# EasyEDA Pro project Project_first.eprj, schematic Schematic7 (continued)
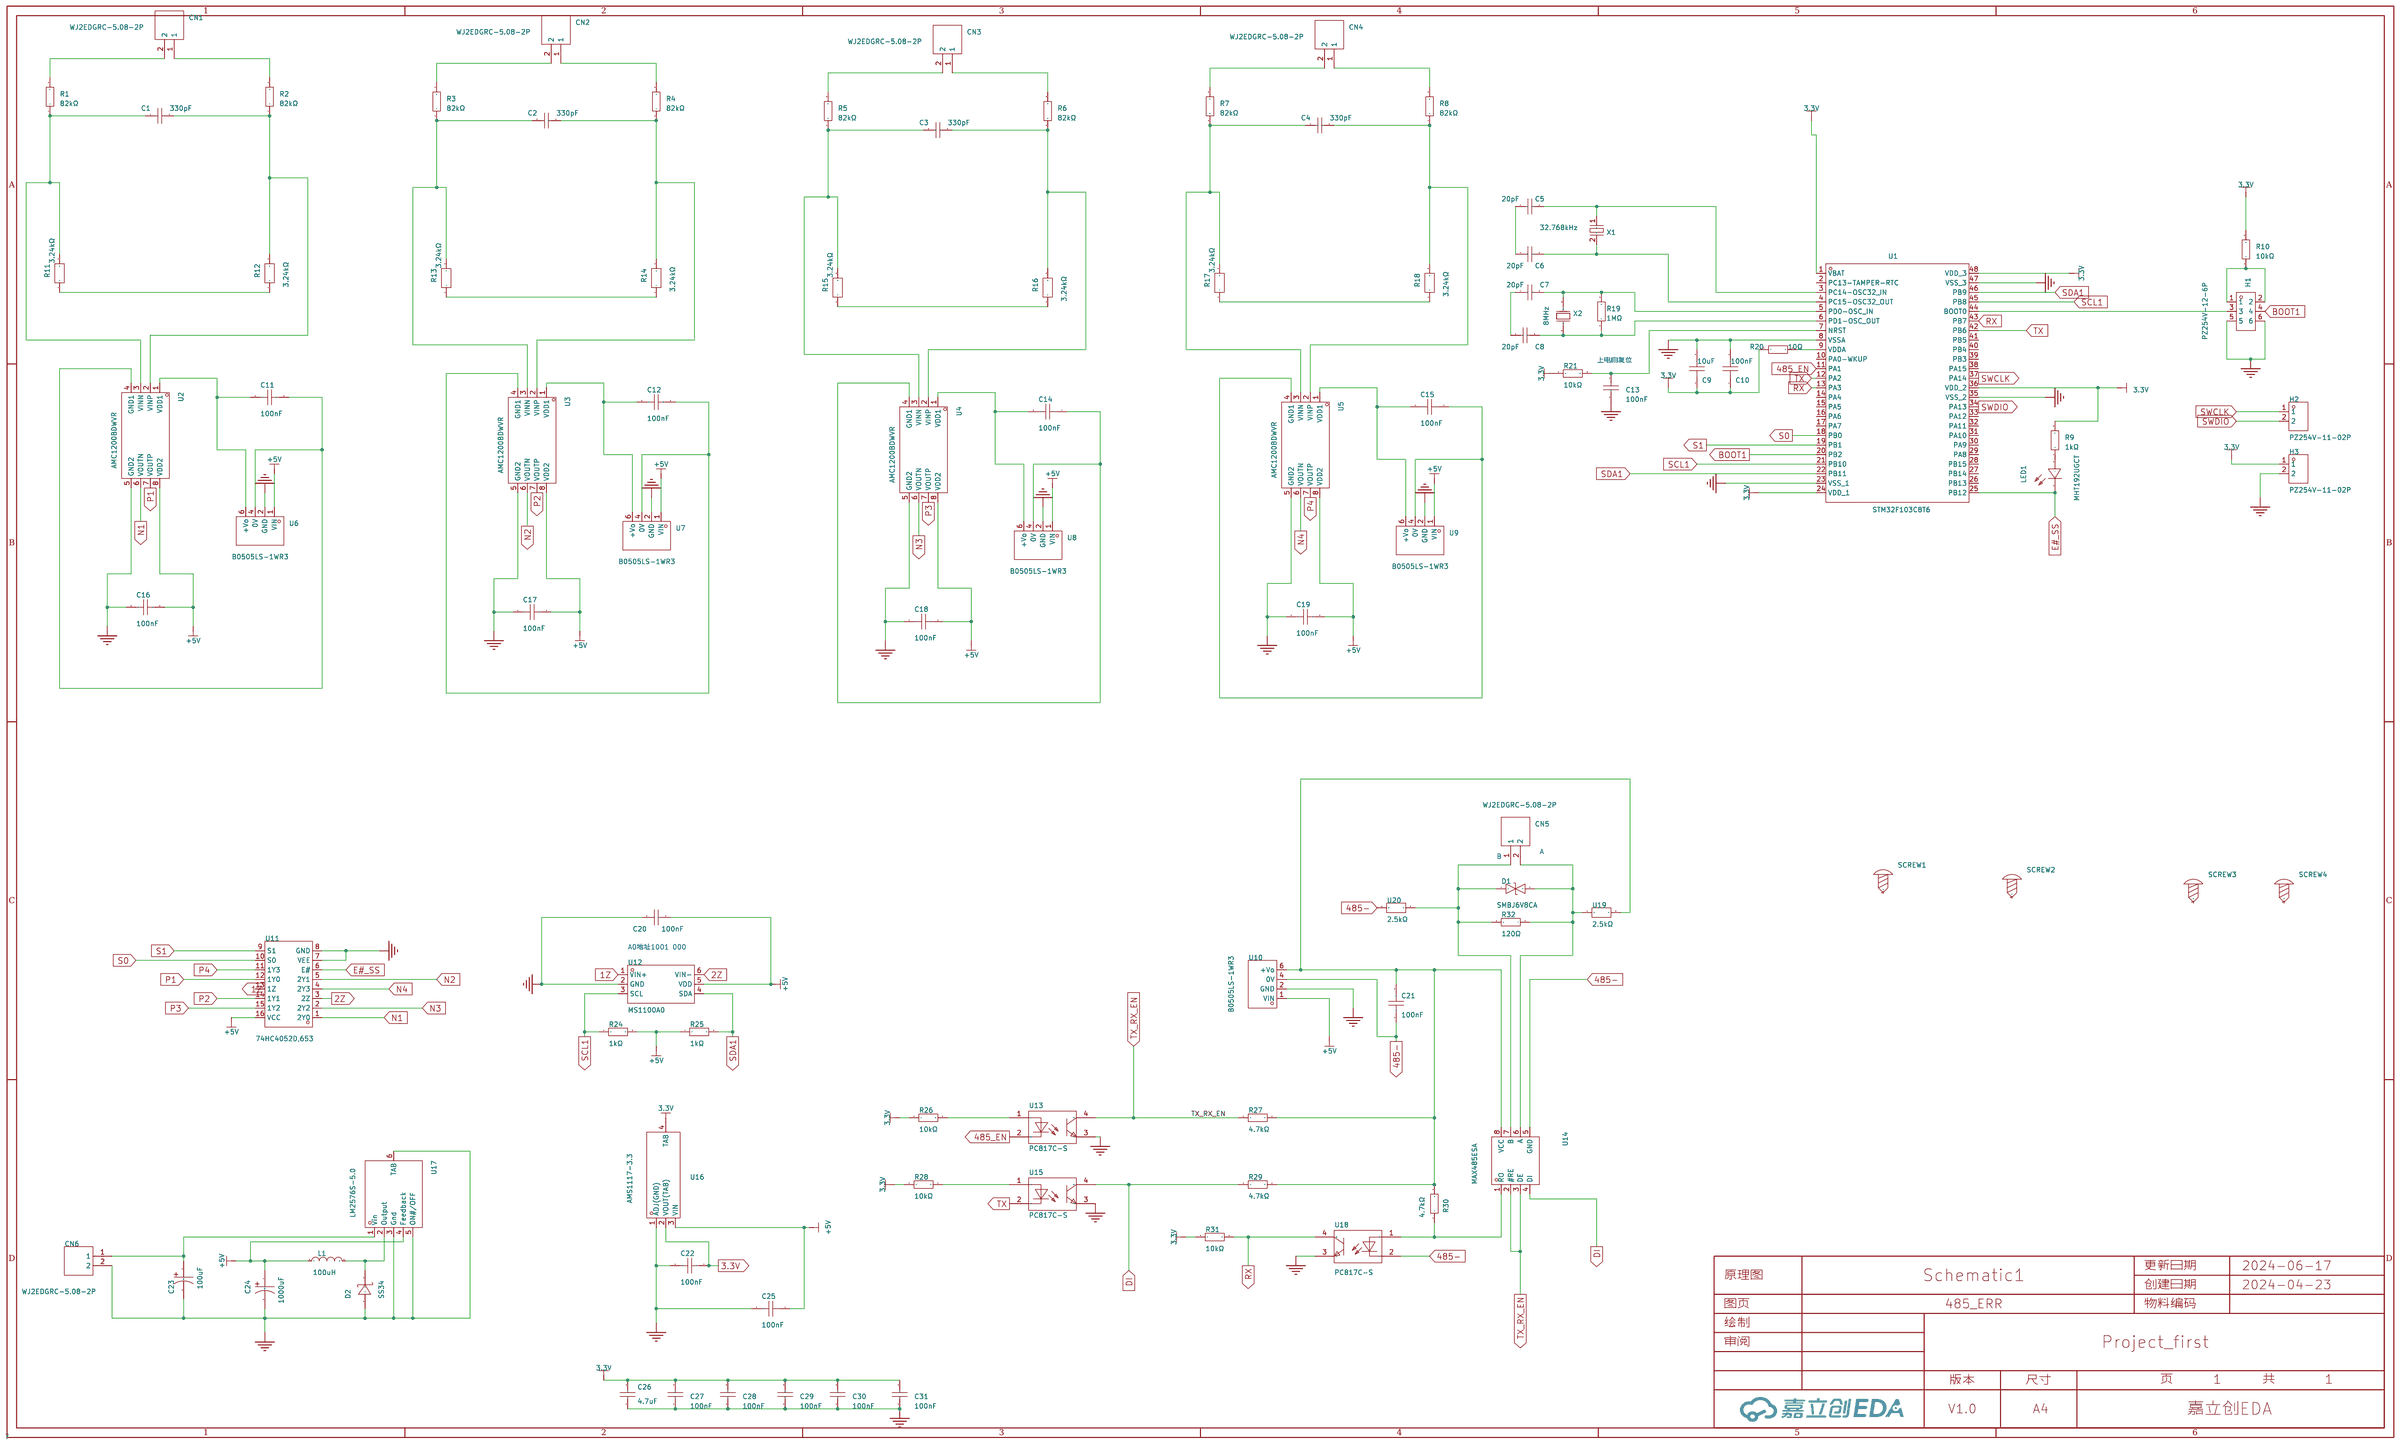
[diagram p0: schematic sheet]
## Library data of the parts (continued)
C7 C8 C10 C27 C33 = CC0603KRX7R9BB104: 容值:100nF;精度:±10%;额定电压:50V;材质(温度系数):X7R;; LCSC Part Name: 100nF ±10% 50V; Supplier Part: C14663; Manufacturer: YAGEO(国巨); Supplier Footprint: 0603; JLCPCB Part Class: Basic Part; Datasheet: https://atta.szlcsc.com/upload/public/pdf/source/20180910/C282072_33301C7F631E79921B82A8DAC6BCC5B3.pdf; Supplier: LCSC; Tolerance: ±10%; Voltage Rated: 50V; Temperature Coefficient: X7R
C16 = ERS1HM681W20OT: 容值:680uF;精度:±20%;额定电压:50V;; LCSC Part Name: 680uF ±20% 50V; Supplier Part: C106668; Manufacturer: AISHI(艾华集团); Supplier Footprint: 插件,D12.5xL20mm; JLCPCB Part Class: Extended Part; Datasheet: https://atta.szlcsc.com/upload/public/pdf/source/20191015/C438940_4B8E60A742BB0AE40DDEF87A5C89089D.pdf; Supplier: LCSC; Tolerance: ±20%; Rated Voltage: 50V; Lead Spacing: 5mm; φD: 12.5mm; L: 20mm; Lifetime @ Temp: 10000hrs@105℃
C17 = GR227M025E12RR0VH4FP0: 容值:220uF;精度:±20%;额定电压:25V;纹波电流:-;等效串联电阻:-;; LCSC Part Name: 220uF ±20% 25V 黑; Supplier Part: C43838; Manufacturer: CX(承兴); Supplier Footprint: 插件,D6.3xL12mm; JLCPCB Part Class: Extended Part; Datasheet: https://atta.szlcsc.com/upload/public/pdf/source/20211027/ED0DA65C69F42D9BDEC91091BA4C03CD.pdf; Supplier: LCSC; Tolerance: ±20%; Rated Voltage: 25V; Lead Spacing: 2.5mm; φD: 6.3mm; L: 12mm; Lifetime @ Temp: 2000hrs@105℃; Operating Temperature: -40℃~+105℃
C20 C21 C34-C37 = CC0603KRX7R9BB104: 容值:100nF;精度:±10%;额定电压:50V;材质(温度系数):X7R;; LCSC Part Name: 100nF ±10% 50V; Supplier Part: C14663; Manufacturer: YAGEO(国巨); Supplier Footprint: 0603; JLCPCB Part Class: Basic Part; Datasheet: https://atta.szlcsc.com/upload/public/pdf/source/20180910/C282072_33301C7F631E79921B82A8DAC6BCC5B3.pdf; Supplier: LCSC; Tolerance: ±10%; Voltage Rated: 50V; Temperature Coefficient: X7R; Check: true
C28-C31 = 0603B331K500NT: 容值:330pF;精度:±10%;额定电压:50V;材质(温度系数):X7R;; LCSC Part Name: 330pF ±10% 50V; Supplier Part: C1612; Manufacturer: FH(风华); Supplier Footprint: 0603; JLCPCB Part Class: Extended Part; Datasheet: https://atta.szlcsc.com/upload/public/pdf/source/20200305/C486355_26A10D38EF8C2A5C37091D0039909270.pdf; Supplier: LCSC; Tolerance: ±10%; Voltage Rated: 50V; Temperature Coefficient: X7R; Check: true
C32 = CL05B104KO5NNNC: 容值:100nF;精度:±10%;额定电压:16V;材质(温度系数):X7R;; LCSC Part Name: 100nF ±10% 16V; Supplier Part: C1525; Manufacturer: SAMSUNG(三星); Supplier Footprint: 0402; JLCPCB Part Class: Basic Part; Datasheet: https://atta.szlcsc.com/upload/public/pdf/source/20160218/1457707763339.pdf; Supplier: LCSC; Tolerance: ±10%; Voltage Rated: 16V; Temperature Coefficient: X7R; Check: true
D2 D3 = SS34_C8678: 二极管配置:独立式;正向压降(Vf):550mV@3A;直流反向耐压(Vr):40V;平均整流电流(Io):3A;; LCSC Part Name: 电压:40V 电流:3A; Supplier Part: C8678; Manufacturer: MDD; Supplier Footprint: SMA(DO-214AC); JLCPCB Part Class: Basic Part; Datasheet: https://atta.szlcsc.com/upload/public/pdf/source/20230314/A80AE34493C69B89E2F4B1712F433538.pdf; Supplier: LCSC; Diode Configuration: 独立式; Forward Voltage (Vf@If): 550mV@3A; Reverse Voltage (Vr): 40V; Average Rectified Current (Io): 3A; Reverse Leakage Current (Ir): 500uA@40V
D4 = SS54_C7420369: 二极管配置:独立式;正向压降(Vf):550mV@5.0A;直流反向耐压(Vr):40V;平均整流电流(Io):5A;; LCSC Part Name: 电压:40V 电流:5A; Supplier Part: C7420369; Manufacturer: 宏迦橙; Supplier Footprint: SMA(DO-214AC); JLCPCB Part Class: Extended Part; Datasheet: https://atta.szlcsc.com/upload/public/pdf/source/20230828/254C3882F8647358AD9F60DD73611B5E.pdf; Supplier: LCSC; Diode Configuration: 独立式; Forward Voltage (Vf@If): 550mV@5.0A; Reverse Voltage (Vr): 40V; Average Rectified Current (Io): 5A; Reverse Leakage Current (Ir): 50uA@40V; Peak forward surge current: 120A
D5 = P6SMB6.8CA/TR13: 反向截止电压(Vrwm):5.8V;最大钳位电压:10.5V;峰值脉冲电流(Ipp)@10/1000us:58.1A;峰值脉冲功率(Ppp)@10/1000us:600W;击穿电压:6.45V;; Supplier Part: C78395; Manufacturer: Brightking(君耀电子); Supplier Footprint: SMB(DO-214AA); JLCPCB Part Class: Basic Part; Datasheet: https://atta.szlcsc.com/upload/public/pdf/source/20160709/1468031879762.pdf; Supplier: LCSC; Reverse Stand-Off Voltage (Vrwm): 5.8V; Maximum Clamping Voltage: 10.5V; Peak Pulse Current (Ipp)@10/1000us: 58.1A; Peak Pulse Power Dissipation (Ppp)@10/1000us: 600W; Breakdown Voltage: 6.45V; Type: TVS
Debug H5 H8 IIC = PZ254V-11-04P: 插针结构:1x4P;间距:2.54mm;行距:-;圆针/方针:方针;安装类型:直插;排数:单排;总PIN位数:4P;额定电流:3A;额定电压:250V;配合针长度:6mm;塑高:2.5mm;端接针长度:3mm;触头材质:-;工作温度范围:-40℃~+105℃;颜色:黑色;; LCSC Part Name: 间距:2.54mm 1x4P 直插 方针; Supplier Part: C2691448; Manufacturer: XFCN(兴飞); Supplier Footprint: 插件,P=2.54mm; JLCPCB Part Class: Extended Part; Datasheet: https://atta.szlcsc.com/upload/public/pdf/source/20200309/C492403_F9F19131791D08044AD4F84F8E751A34.pdf; Supplier: LCSC; Pin Structure: 1x4P; Pitch: 2.54mm; Circluar Pins/Square Pins: 方针; Mounting Type: 直插; Number of Rows: 单排; Number of Pins: 4P; Current Rating (Max): 3A; Voltage Rating (Max): 250V; Length of Mating Pin: 6mm; Insulation Height: 2.5mm; Length of End Connection Pin: 3mm; Operating Temperature Range: -40℃~+105℃; Color: 黑色
H1 H4 H7 USART1 = PZ254V-11-02P: 插针结构:1x2P;间距:2.54mm;行距:-;圆针/方针:方针;安装类型:直插;排数:单排;总PIN位数:2P;额定电流:-;额定电压:-;配合针长度:6mm;塑高:2.5mm;端接针长度:3mm;触头材质:黄铜;触头镀层:-;工作温度范围:-40℃~+105℃;颜色:黑色;; LCSC Part Name: 间距:2.54mm 1x2P 直插 方针; Supplier Part: C492401; Manufacturer: XFCN(兴飞); Supplier Footprint: 插件,P=2.54mm; JLCPCB Part Class: Extended Part; Datasheet: https://atta.szlcsc.com/upload/public/pdf/source/20200309/C492401_A812433581A9B211A7FFA413ADDFF0E5.pdf; Supplier: LCSC; Pin Structure: 1x2P; Pitch: 2.54mm; Circluar Pins/Square Pins: 方针; Mounting Type: 直插; Number of Rows: 单排; Number of Pins: 2P; Length of Mating Pin: 6mm; Insulation Height: 2.5mm; Length of End Connection Pin: 3mm; Contact Material: 黄铜; Operating Temperature Range: -40℃~+105℃; Color: 黑色
H3 = 2.54-1*4P母: 插孔结构:1x4P;间距:2.54mm;行距:-;圆孔/方孔:方孔;安装类型:直插;排数:单排;总孔位数:4P;额定电流:3A;额定电压:-;插孔方向:顶部;塑高:-;触头材质:青铜;触头镀层:-;工作温度范围:-40℃~+105℃;焊接温度(最大值):-;; LCSC Part Name: 间距:2.54mm 1x4P 直插; Supplier Part: C2718488; Manufacturer: BOOMELE(博穆精密); Supplier Footprint: 插件,P=2.54mm; JLCPCB Part Class: Extended Part; Datasheet: https://atta.szlcsc.com/upload/public/pdf/source/20210301/C2718488_F4427B881E42CAA8DDB0B1C12B3A522C.pdf; Supplier: LCSC; Holes Structure: 1x4P; Pitch: 2.54mm; Circular Hole / Square Hole: 方孔; Mounting Type: 直插; Number of Rows: 单排; Number of Holes: 4P; Current Rating (Max): 3A; Holes Direction: 顶部; Contact Material: 青铜; Operating Temperature Range: -40℃~+105℃
H6 = 2.54-1*3P针: 插针结构:1x3P;间距:2.54mm;行距:-;圆针/方针:方针;安装类型:直插;排数:单排;总PIN位数:3P;额定电流:3A;额定电压:-;配合针长度:-;塑高:-;端接针长度:-;触头材质:-;触头镀层:-;工作温度范围:-40℃~+105℃;颜色:黑色;; LCSC Part Name: 间距:2.54mm 1x3P 直插 方针; Supplier Part: C49257; Manufacturer: BOOMELE(博穆精密); Supplier Footprint: 插件,P=2.54mm; JLCPCB Part Class: Extended Part; Datasheet: https://atta.szlcsc.com/upload/public/pdf/source/20221018/3E9408392E35E6F57A28985E5F7BF5C9.pdf; Supplier: LCSC; Pin Structure: 1x3P; Pitch: 2.54mm; Circluar Pins/Square Pins: 方针; Mounting Type: 直插; Number of Rows: 单排; Number of Pins: 3P; Current Rating (Max): 3A; Operating Temperature Range: -40℃~+105℃; Color: 黑色
H10 = 2.54-1x6P直针: 插针结构:1x6P;间距:2.54mm;行距:-;圆针/方针:方针;安装类型:直插;排数:单排;总PIN位数:6P;额定电流:3A;额定电压:-;配合针长度:-;塑高:-;触头材质:黄铜;触头镀层:-;工作温度范围:-40℃~+105℃;颜色:黑色;; LCSC Part Name: 间距:2.54mm 1x6P 直插 方针; Supplier Part: C37208; Manufacturer: BOOMELE(博穆精密); Supplier Footprint: 插件,P=2.54mm; JLCPCB Part Class: Extended Part; Supplier: LCSC; Pin Structure: 1x6P; Pitch: 2.54mm; Circluar Pins/Square Pins: 方针; Mounting Type: 直插; Number of Rows: 单排; Number of Pins: 6P; Current Rating (Max): 3A; Contact Material: 黄铜; Operating Temperature Range: -40℃~+105℃; Color: 黑色
K1 = G2R-1-E-DC24V: 线圈电压:-;触点形式:-;触点容量(电阻负载):-;最大切换电压:-;最大切换电流:-;; Supplier Part: C133339; Manufacturer: OMRON(欧姆龙); Supplier Footprint: DIP,12.6x28.6mm; JLCPCB Part Class: Extended Part; Supplier: LCSC
L1 = CD32YP0302-330M: 电感值:33uH;精度:±20%;额定电流:600mA;; LCSC Part Name: 33uH ±20%; Supplier Part: C492262; Manufacturer: YJYCOIN(益嘉源); Supplier Footprint: SMD,3.5x3x2.1mm; JLCPCB Part Class: Extended Part; Datasheet: https://atta.szlcsc.com/upload/public/pdf/source/20200311/C492266_3C4DCA97B8B94D4CA8DBD234C7C1D8A4.pdf; Supplier: LCSC; Tolerance: ±20%; Rated Current: 600mA; DC Resistance (DCR): 951mΩ
LED1 LED2 = MHT192UGCT: 发光颜色:翠绿色;功率:60mW;正向电流:20mA;主波长:515nm~530nm;二极管配置:-;透镜颜色:无色透明透镜;色温:-;发光角度:120°;载带方式:-;工作温度:-40℃~+85℃;; LCSC Part Name: 翠绿; Supplier Part: C389519; Manufacturer: MEIHUA(美华); Supplier Footprint: 0603; JLCPCB Part Class: Extended Part; Datasheet: https://atta.szlcsc.com/upload/public/pdf/source/20190515/C389519_7BC27E831414348C8AF19AF18EE4BF58.pdf; Supplier: LCSC; Emitted Color: 翠绿色; Power Dissipation: 60mW; Forward Current: 20mA; Dominant Wavelength: 515nm~530nm; Peak Wavelength: 518nm; Lens Color: 无色透明透镜; Viewing Angle: 120°; Operating Temperature: -40℃~+85℃
LM2596S = LM2596S-5.0_C347421: 功能类型:降压型;输出类型:固定;输入电压:40V;输出电压:5V;输出电流(最大值):3A;; Supplier Part: C347421; Manufacturer: UMW(友台半导体); Supplier Footprint: TO-263-5; JLCPCB Part Class: Extended Part; Datasheet: https://atta.szlcsc.com/upload/public/pdf/source/20230506/0930E65C3A8B7B120C8A4D8E5A8AC327.pdf; Supplier: LCSC; Function: 降压型; Output Type: 固定; Input Voltage: 40V; Output Voltage: 5V; Output Current (Max): 3A; Switching Frequency: 150kHz; Operating Temperature: -40℃~+125℃@(TA); Synchronous Rectification: 否; Number of Outputs: 1; Topology: 降压式; Switch tube (built-in/external): 内置
MARK1 = Mark-Point: Mark点
R1 R3 R5-R7 R9 R10 R14 R36 R37 R40 = 0805W8F1002T5E_C17414: 电阻类型:厚膜电阻;阻值:10kΩ;精度:±1%;功率:125mW;最大工作电压:150V;温度系数:±100ppm/℃;; LCSC Part Name: 10kΩ ±1% 125mW 厚膜电阻; Supplier Part: C17414; Manufacturer: UNI-ROYAL(厚声); Manufacturer Part: 0805W8F1002T5E; Supplier Footprint: 0805; JLCPCB Part Class: Basic Part; Datasheet: https://atta.szlcsc.com/upload/public/pdf/source/20200306/C422600_1E6D84923E4A46A82E41ADD87F860B5C.pdf; Supplier: LCSC; Type: 厚膜电阻; Tolerance: ±1%; Power(Watts): 125mW; Overload Voltage (Max): 150V; Temperature Coefficient: ±100ppm/℃; Operating Temperature Range: -55℃~+155℃
R2 R13 R16 R99 = 0603WAF1200T5E: 电阻类型:厚膜电阻;阻值:120Ω;精度:±1%;功率:100mW;最大工作电压:75V;温度系数:±100ppm/℃;; LCSC Part Name: 120Ω ±1% 100mW 厚膜电阻; Supplier Part: C22787; Manufacturer: UNI-ROYAL(厚声); Supplier Footprint: 0603; JLCPCB Part Class: Basic Part; Datasheet: https://atta.szlcsc.com/upload/public/pdf/source/20200306/C422600_1E6D84923E4A46A82E41ADD87F860B5C.pdf; Supplier: LCSC; Type: 厚膜电阻; Tolerance: ±1%; Power(Watts): 100mW; Overload Voltage (Max): 75V; Temperature Coefficient: ±100ppm/℃; Operating Temperature Range: -55℃~+155℃
R4 R8 R11 R12 R15 R17 = 0805W8F1001T5E: 电阻类型:厚膜电阻;阻值:1kΩ;精度:±1%;功率:125mW;最大工作电压:150V;温度系数:±100ppm/℃;; LCSC Part Name: 1kΩ ±1% 125mW 厚膜电阻; Supplier Part: C17513; Manufacturer: UNI-ROYAL(厚声); Supplier Footprint: 0805; JLCPCB Part Class: Basic Part; Datasheet: https://atta.szlcsc.com/upload/public/pdf/source/20200306/C422600_1E6D84923E4A46A82E41ADD87F860B5C.pdf; Supplier: LCSC; Type: 厚膜电阻; Tolerance: ±1%; Power(Watts): 125mW; Overload Voltage (Max): 150V; Temperature Coefficient: ±100ppm/℃; Operating Temperature Range: -55℃~+155℃
R18-R25 = 1206W4F8202T5E: 电阻类型:厚膜电阻;阻值:82kΩ;精度:±1%;功率:250mW;最大工作电压:200V;温度系数:±100ppm/℃;; LCSC Part Name: 82kΩ ±1% 250mW 厚膜电阻; Supplier Part: C17979; Manufacturer: UNI-ROYAL(厚声); Supplier Footprint: 1206; JLCPCB Part Class: Extended Part; Datasheet: https://atta.szlcsc.com/upload/public/pdf/source/20200306/C422600_1E6D84923E4A46A82E41ADD87F860B5C.pdf; Supplier: LCSC; Type: 厚膜电阻; Tolerance: ±1%; Power(Watts): 250mW; Overload Voltage (Max): 200V; Temperature Coefficient: ±100ppm/℃; Operating Temperature Range: -55℃~+155℃; Check: true
R26-R33 = FRC1206F3241TS: 电阻类型:厚膜电阻;阻值:3.24kΩ;精度:±1%;功率:250mW;最大工作电压:200V;温度系数:±100ppm/℃;; LCSC Part Name: 3.24kΩ ±1% 250mW 厚膜电阻; Supplier Part: C5153989; Manufacturer: FOJAN(富捷); Supplier Footprint: 1206; JLCPCB Part Class: Extended Part; Datasheet: https://atta.szlcsc.com/upload/public/pdf/source/20211221/925EC7D7225764EE0046F22065062C87.pdf; Supplier: LCSC; Type: 厚膜电阻; Tolerance: ±1%; Power(Watts): 250mW; Overload Voltage (Max): 200V; Temperature Coefficient: ±100ppm/℃; Check: true
Reset = TS-1002S-04326C: 电路结构:单刀单掷;按钮形状:圆形按钮;安装方式:立贴;开关长度:6mm;开关宽度:6mm;开关高度:4.3mm;触点电流:50mA;额定电压(DC):12V;带灯:-;机械寿命:-;; LCSC Part Name: 6*6*4.3mm 立贴 轻触开关; Supplier Part: C455108; Manufacturer: XUNPU(讯普); Supplier Footprint: SMD,6x6mm; JLCPCB Part Class: Extended Part; Datasheet: https://atta.szlcsc.com/upload/public/pdf/source/20191118/C455126_F61E8FA1ED640FB1CE0B30B55DEB62E3.pdf; Supplier: LCSC; Circuit: 单刀单掷; Actuator Style: 圆形按钮; Mounting Style: 立贴; Switch Length: 6mm; Switch Width: 6mm; Switch Height: 4.3mm; Contact Current: 50mA; Voltage Rating (DC): 12V
RS232 = SP3232EEN-L/TR: 类型:收发器;驱动器/接收器:2/2;数据速率:235Kbps;; LCSC Part Name: 3.0V至5.5V RS-232收发器; Supplier Part: C9378; Manufacturer: MaxLinear(迈凌); Supplier Footprint: SOIC-16; JLCPCB Part Class: Extended Part; Datasheet: https://atta.szlcsc.com/upload/public/pdf/source/20201223/C9378_07B7140F492E50475A665D5A3819EE11.pdf; Supplier: LCSC; Types: 收发器; Driver/receiver: 2/2; Data Rate: 235Kbps; Supply Voltage: 3V~5.5V; Operating Temperature: -40℃~+85℃
SCREW1-SCREW4 = M3螺丝: Supplier Footprint: 插件
STM1 = STM32F103C8T6: CPU内核:CM3;程序存储容量:64KB;RAM总容量:20KB;GPIO端口数量:37;工作电压范围:2V~3.6V;CPU最大主频:72MHz;程序存储器类型:FLASH;; LCSC Part Name: STM32F103C8T6 MSL=3; Supplier Part: C8734; Manufacturer: ST(意法半导体); Supplier Footprint: LQFP-48(7x7); JLCPCB Part Class: Extended Part; Datasheet: https://atta.szlcsc.com/upload/public/pdf/source/20220812/8363ACEC51AD55ECEB84799464F7CB85.pdf; Supplier: LCSC; CPU Core: CM3; Program Storage Size: 64KB; RAM Size: 20KB; GPIO Ports Number: 37; Operating Voltage Range: 2V~3.6V; CPU Maximum Speed: 72MHz; Program Memory Type: FLASH; Operating Temperature Range: -40℃~+85℃; ADC (Bit): 12bit; Universal Serial Bus: 有; Peripheral/Function: 看门狗；DMA；看门狗；片载温度传感器; Watchdog: 有; Infrared Data Association: 有; Low-Voltage Detect: 有; Direct Memory Access: 有; Internal Oscillator: 有
Type-C = TYPE-C-31-M-12: 连接器类型:Type-C;标准:-;公母:母;端口数量:1;触点数量:16P;安装方式:-;额定电流 - 电源:5A;触头材质:-;触头镀层:-;工作温度范围:-;焊接温度(最大值):-;; LCSC Part Name: Type-C 母; Supplier Part: C165948; Manufacturer: 韩国韩荣; Supplier Footprint: SMD; JLCPCB Part Class: Extended Part; Datasheet: https://atta.szlcsc.com/upload/public/pdf/source/20220525/466408E853115E789EDB0DDC29077C05.pdf; Supplier: LCSC; Gender: 母; Number of Ports: 1; Number of Contacts: 16P; Current Rating - Power (Max): 5A
U1 = SIT1050T: 类型:收发器;数据速率:1Mbps;; LCSC Part Name: 1Mbps 4.5V~5.5V; Supplier Part: C313021; Manufacturer: SIT(芯力特); Supplier Footprint: SO-8; JLCPCB Part Class: Extended Part; Datasheet: https://atta.szlcsc.com/upload/public/pdf/source/20190522/C313021_F295A63AE262020D1D58DBA99C3629E3.pdf; Supplier: LCSC; Type: 收发器; Data Rate: 1Mbps; Supply Voltage: 4.5V~5.5V
U2 = CH340N: LCSC Part Name: USB转串口芯片 CH340; Supplier Part: C2977777; Manufacturer: WCH(南京沁恒); Supplier Footprint: SOP-8; JLCPCB Part Class: Extended Part; Datasheet: https://atta.szlcsc.com/upload/public/pdf/source/20230530/6E401E9554E9F5311886CC8B3F89B62E.pdf; Supplier: LCSC
U3 = B0505LS-1WR3_C5365294: 输入电压(DC):4.5V~5.5V;输出电压:5V;输出功率:1W;输出电流(最大值):200mA;; LCSC Part Name: 直流隔离电源模块5V转5V短路保护; Supplier Part: C5365294; Manufacturer: HI-LINK(海凌科); Supplier Footprint: 插件; Supplier: LCSC; Input Voltage(DC): 4.5V~5.5V; Output Voltage: 5V; Output Power: 1W; Output Current (Max): 200mA; Isolation or not: 隔离; Insulated Voltage: 1.5kV; Feature: 短路保护; Check: true
U4-U7 = AMC1200BDWVR: 放大器数:单路;-3dB带宽:100kHz;输入偏置电流(Ib):-;输入失调电压(Vos):200uV;; Supplier Part: C79905; Manufacturer: TI(德州仪器); Supplier Footprint: SOIC-8-300mil; JLCPCB Part Class: Extended Part; Datasheet: https://www.ti.com/cn/lit/gpn/amc1200; Supplier: LCSC; Number of Channels: 单路; Bandwidth (-3dB): 100kHz; Input Offset Voltage (Vos): 200uV; Operating Temperature: -40℃~+105℃; Check: true
ULN1 = ULN2003_C5181464: Supplier Part: C5181464; Manufacturer: HX(恒佳兴); Supplier Footprint: SOP-16; JLCPCB Part Class: Extended Part; Datasheet: https://atta.szlcsc.com/upload/public/pdf/source/20220927/953E11A5419733CE1D96D2BF29C556EC.pdf; Supplier: LCSC
PC2 = PC817C-S: LCSC Part Name: 光耦; Supplier Part: C3008369; Manufacturer: UMW(友台半导体); Supplier Footprint: SOP-4-2.54mm; JLCPCB Part Class: Extended Part; Datasheet: https://atta.szlcsc.com/upload/public/pdf/source/20231109/4644CC05A9D09AF3A1056B42E9A17852.pdf; Supplier: LCSC
Q2 = IRF740PBF: 类型:1个N沟道;漏源电压(Vdss):400V;连续漏极电流(Id):10A;功率(Pd):125W;导通电阻(RDS(on)@Vgs,Id):550mΩ@10V,6A;阈值电压(Vgs(th)@Id):4V@250uA;; LCSC Part Name: 1个N沟道 耐压:400V 电流:10A; Supplier Part: C2570; Manufacturer: VISHAY(威世); Supplier Footprint: TO-220AB; JLCPCB Part Class: Extended Part; Datasheet: https://atta.szlcsc.com/upload/public/pdf/source/20140822/1457707233298.pdf; Supplier: LCSC; Type: 1个N沟道; Drain Source Voltage (Vdss): 400V; Continuous Drain Current (Id): 10A; Power Dissipation (Pd): 125W; Drain Source On Resistance (RDS(on)@Vgs,Id): 550mΩ@10V,6A; Gate Threshold Voltage (Vgs(th)@Id): 4V@250uA; Total Gate Charge (Qg@Vgs): 63nC@10V; Input Capacitance (Ciss@Vds): 1.4nF@25V; Operating Temperature: -55℃~+150℃@(Tj)
Q4 = S8050 J3Y_C2146: 晶体管类型:NPN;集电极电流(Ic):500mA;集射极击穿电压(Vceo):25V;功率(Pd):300mW;直流电流增益(hFE@Ic,Vce):200@50mA,1V;; LCSC Part Name: S8050 J3Y(RANGE:200-350) H档(200-350); Supplier Part: C2146; Manufacturer: CJ(江苏长电/长晶); Supplier Footprint: SOT-23; JLCPCB Part Class: Basic Part; Datasheet: https://atta.szlcsc.com/upload/public/pdf/source/20140809/1457707209234.pdf; Supplier: LCSC; Transistor Type: NPN; Collector Current (Ic): 500mA; Collector-Emitter Breakdown Voltage (Vceo): 25V; Power Dissipation (Pd): 300mW; DC Current Gain (hFE@Ic,Vce): 200@50mA,1V; Transition Frequency (fT): 150MHz; Collector Cut-Off Current (Icbo): 100nA; Collector-Emitter Saturation Voltage (VCE(sat)@Ic,Ib): 600mV@500mA,50mA
R41-R43 = 25121WF100JT4E: 电阻类型:厚膜电阻;阻值:10Ω;精度:±1%;功率:1W;最大工作电压:200V;温度系数:±400ppm/℃;; LCSC Part Name: 10Ω ±1% 1W 厚膜电阻; Supplier Part: C47019; Manufacturer: UNI-ROYAL(厚声); Supplier Footprint: 2512; JLCPCB Part Class: Extended Part; Datasheet: https://atta.szlcsc.com/upload/public/pdf/source/20200306/C422600_1E6D84923E4A46A82E41ADD87F860B5C.pdf; Supplier: LCSC; Type: 厚膜电阻; Tolerance: ±1%; Power(Watts): 1W; Overload Voltage (Max): 200V; Temperature Coefficient: ±400ppm/℃; Operating Temperature Range: -55℃~+155℃
U9 = LL4148_C5345986: 二极管配置:独立式;正向压降(Vf):1V@10mA;直流反向耐压(Vr):75V;平均整流电流(Io):200mA;反向恢复时间(trr):4ns;; LCSC Part Name: 电压:75V 电流:200mA; Supplier Part: C5345986; Manufacturer: HXY MOSFET(华轩阳电子); Supplier Footprint: LL-34; JLCPCB Part Class: Extended Part; Datasheet: https://atta.szlcsc.com/upload/public/pdf/source/20230112/39F37BFB527C596A6DA9694C0AB0D599.pdf; Supplier: LCSC; Diode Configuration: 独立式; Forward Voltage (Vf@If): 1V@10mA; Reverse Voltage (Vr): 75V; Average Rectified Current (Io): 200mA; Reverse Leakage Current: 5uA@75V; Reverse Recovery Time (trr): 4ns

## Nets
3.3V: 1117.2(VOUT) 1117.4(TAB) boot-ss.1 boot-ss.2 C6.2 C8.1 C9.2 C11.2 C12.1 C13.1 C14.1 C18.1 C19.1 C22.2 Debug.4 IIC.3 LED1.2(+) R1.2 R10.1 R11.2 R12.1 RS232.16(VCC) STM1.1(VBAT) STM1.9(VDDA) STM1.24(VDD_1) STM1.36(VDD_2) STM1.48(VDD_3) U2.8(V3)
5V+: C21.1 U3.6(+Vo) U4.1(VDD1) U5.1(VDD1) U6.1(VDD1) U7.1(VDD1)
5V-: C21.2 U3.4(0V) U4.4(GND1) U5.4(GND1) U6.4(GND1) U7.4(GND1)
10V: PC2.4(COL) R42.1 R43.2
24V+: 500V1.1 R14.1 R42.2
24V-: 500V1.2 Q4.2(E) R41.1 R43.1 ULN1.9(COM)
+5V: 2.8(VCC) 74H.16(VCC) AD1.5(VDD) C7.1 C10.1 C17.1 C20.2 C27.1 C32.1 C33.2 C34.1 C35.1 C36.1 C37.1 D3.2(A) L1.2 LM2596S.4(FB) R4.1 R17.1 Type-C.A4(VBUS) Type-C.A9(VBUS) Type-C.B4(VBUS) Type-C.B9(VBUS) U1.3(VCC) U2.5(VCC) U3.1(VIN) U4.8(VDD2) U5.8(VDD2) U6.8(VDD2) U7.8(VDD2)
GND: 2.5(GND) 24V.2 74H.7(VEE) 74H.8(GND) 1117.1(GND) AD1.2(GND) boot-ss.5 boot-ss.6 C1.1 C2.2 C3.1 C4.2 C5.2 C6.1 C7.2 C8.2 C9.1 C10.2 C11.1 C12.2 C13.2 C14.2 C15.1 C16.2 C17.2 C18.2 C19.2 C20.1 C22.1 C24.2 C26.2 C27.2 C32.2 C33.1 C34.2 C35.2 C36.2 C37.2 D4.1(A) Debug.3 IIC.4 LED2.1(-) LM2596S.3(GND) LM2596S.5(ON#/OFF) LM2596S.6(EP) PC2.2(CAT) R3.2 R7.2 R9.1 R13.2 R15.2 Reset.1 Reset.2 STM1.8(VSSA) STM1.23(VSS_1) STM1.35(VSS_2) STM1.47(VSS_3) Type-C.A1(GND) Type-C.A12(GND) Type-C.B1(GND) Type-C.B12(GND) U1.2(GND) U2.3(GND) U3.2(GND) U4.5(GND2) U5.5(GND2) U6.5(GND2) U7.5(GND2) ULN1.8(E)
1Z: 74H.13(1Z) AD1.1(VIN+) P17.2
2Z: 74H.3(2Z) AD1.6(VIN-) P17.1
232IN: RS1.1 RS232.8(R2IN) RS232.13(R1IN)
232OUT: RS1.2 RS232.7(T2OUT) RS232.14(T1OUT)
BOOT0: R5.1 STM1.44(BOOT0)
BOOT1: R6.2 STM1.20(PB2)
CAN_RX: H5.4 STM1.45(PB8) U1.4(RXD) ULN1.4(4B)
CAN_TX: STM1.46(PB9) U1.1(TXD)
D+: H7.1 STM1.33(PA12) Type-C.A6(DP1) Type-C.B7(DN2) U2.1(UD+)
D-: STM1.32(PA11) Type-C.A7(DN1) Type-C.B6(DP2) U2.2(UD-)
E#_SS: 74H.6(E#) R8.1 STM1.2(PC13-TAMPER-RTC) U2.4(RTS#)
MISO: H3.2 STM1.40(PB4)
MOSI: H3.1 STM1.41(PB5)
N1: 74H.1(2Y0) U5.6(VOUTN)
N2: 74H.5(2Y1) U4.6(VOUTN)
N3: 74H.2(2Y2) U6.6(VOUTN)
N4: 74H.4(2Y3) U7.6(VOUTN)
NRST: C4.1 R1.1 Reset.4 STM1.7(NRST)
NSS: H3.4 STM1.38(PA15)
OSC32_IN: 32.768k.2 C2.1 STM1.3(PC14-OSC32_IN)
OSC32_OUT: 32.768k.1 C5.1 STM1.4(PC15-OSC32_OUT)
OSC_IN: 8M.1(OSC1) C3.2 STM1.5(PD0-OSC_IN)
OSC_OUT: 8M.2(OSC2) C1.2 STM1.6(PD1-OSC_OUT)
P1: 74H.12(1Y0) U5.7(VOUTP)
P2: 74H.14(1Y1) U4.7(VOUTP)
P3: 74H.15(1Y2) U6.7(VOUTP)
P4: 74H.11(1Y3) U7.7(VOUTP)
RO: H9.1 H9.2 RS232.9(R2OUT) RS232.12(R1OUT)
RX1: H5.3 STM1.31(PA10) U2.6(TXD) ULN1.3(3B) USART1.2
RX2: 2.1(RO) STM1.13(PA3)
RX3: H9.3 STM1.22(PB11)
S0: 74H.10(S0) STM1.14(PA4)
S1: 74H.9(S1) STM1.15(PA5)
SCK: H3.3 STM1.39(PB3)
SCL1: AD1.3(SCL) IIC.2 R12.2 STM1.42(PB6)
SDA1: AD1.4(SDA) IIC.1 R11.1 STM1.43(PB7)
SWCLK: Debug.1 STM1.37(PA14)
SWDIO: Debug.2 STM1.34(PA13)
T2CTS: H4.2 STM1.10(PA0-WKUP)
T2RTS: 2.2(#RE) 2.3(DE) H4.1 STM1.11(PA1)
TIM1_BKIN: H7.2 STM1.25(PB12)
TIM1_CH1: H5.1 R99.1 STM1.29(PA8) ULN1.1(1B)
TIM1_CH1N: H6.1 STM1.26(PB13) ULN1.5(5B)
TIM1_CH2: H5.2 STM1.30(PA9) U2.7(RXD) ULN1.2(2B) USART1.1
TIM1_CH2N: H6.2 STM1.27(PB14) ULN1.6(6B)
TIM1_CH3N: H6.3 STM1.28(PB15) ULN1.7(7B)
TIM3_CH1: H8.1 STM1.16(PA6)
TIM3_CH2: H8.2 STM1.17(PA7)
TIM3_CH3: H8.3 STM1.18(PB0)
TIM3_CH4: H8.4 STM1.19(PB1)
TIN: H9.5 H9.6 RS232.10(T2IN) RS232.11(T1IN)
TX2: 2.4(DI) STM1.12(PA2)
TX3: H9.4 STM1.21(PB10)
$1N1353: boot-ss.3 R5.2
$1N1354: boot-ss.4 R6.1
$1N4516: R3.1 U1.8(S)
$1N6374: R9.2 Type-C.2(SH) Type-C.3(SH)
$1N6458: R7.1 Type-C.0(SH) Type-C.1(SH)
$1N6959: D4.2(K) L1.1 LM2596S.2(OUT)
$1N7254: LED2.2(+) R10.2
$1N7393: C16.1 D2.1(K) LM2596S.1(VIN)
$1N9729: R28.1 R29.2
$1N9802: R18.1 R28.2 U5.3(VINN)
$1N9823: R19.1 R29.1 U5.2(VINP)
$1N9913: C28.1 P6.1 R18.2
$1N9919: C28.2 P6.2 R19.2
$1N10400: R26.1 R27.2
$1N10402: R20.1 R26.2 U4.3(VINN)
$1N10408: R21.1 R27.1 U4.2(VINP)
$1N10414: C29.1 P7.1 R20.2
$1N10419: C29.2 P7.2 R21.2
$1N10821: R30.1 R31.2
$1N10823: R22.1 R30.2 U6.3(VINN)
$1N10829: R23.1 R31.1 U6.2(VINP)
$1N10835: C30.1 P8.1 R22.2
$1N10840: C30.2 P8.2 R23.2
$1N11242: R32.1 R33.2
$1N11244: R24.1 R32.2 U7.3(VINN)
$1N11250: R25.1 R33.1 U7.2(VINP)
$1N11256: C31.1 P9.1 R24.2
$1N11261: C31.2 P9.2 R25.2
$1N12103: R4.2 U1.5(Vref)
$1N20615: C24.1 RS232.2(V+)
$1N20617: C26.1 RS232.6(V-)
$1N20723: C23.2 RS232.1(C1+)
$1N20727: C23.1 RS232.3(C1-)
$1N20733: C25.2 RS232.4(C2+)
$1N20736: C25.1 RS232.5(C2-)
$1N24159: R13.1 RS232.15(GND)
$1N24707: LED1.1(-) R8.2
$1N31392: K1.8 ULN1.16(1C)
$1N31456: K1.1 R14.2
$1N31646: K1.3(IN) P4.2
$1N31651: K1.2(NC) P4.1
$1N31660: K1.6(IN) P2.1
$1N31666: K1.5(NO) P2.2
$1N31800: H10.1 ULN1.15(2C)
$1N31802: H10.2 ULN1.14(3C)
$1N31804: H10.3 ULN1.13(4C)
$1N31806: H10.4 ULN1.12(5C)
$1N31808: H10.5 ULN1.11(6C)
$1N31810: H10.6 ULN1.10(7C)
$1N32559: 1117.3(VIN) C15.2 D3.1(K)
$1N32896: 24V.1 D2.2(A)
$1N33061: 2.7(B) D5.2 R15.1 R16.2 RS485.2
$1N33062: 2.6(A) D5.1 R16.1 R17.2 RS485.1
$1N33239: H1.2 R2.2 U1.7(CANH)
$1N33240: H1.1 R2.1 U1.6(CANL)
$2N1955: Q4.1(B) R40.2
$2N1957: Q4.3(C) R36.2 U9.1
$2N1961: Q2.1(G) R36.1 R37.2
$2N1967: PC2.3(EM) R40.1 U9.2
$2N1972: P12.1 Q2.2(D)
$2N1978: P12.2 Q2.3(S) R37.1 R41.2
$2N1990: PC2.1(AN) R99.2

Not connected (* = marked no-connect by the designer): K1 4(NO)* 7(NC)*; MARK1 1; Reset 3*; SCREW1 1; SCREW2 1; SCREW3 1; SCREW4 1; Type-C A5(CC1)* A8(SBU1)* B5(CC2)* B8(SBU2)*

## Notes on the sheets
sheet 1
- A0地址1001 0000
